# Altium schematic sheet FMC_Breakout.SchDoc
size A2
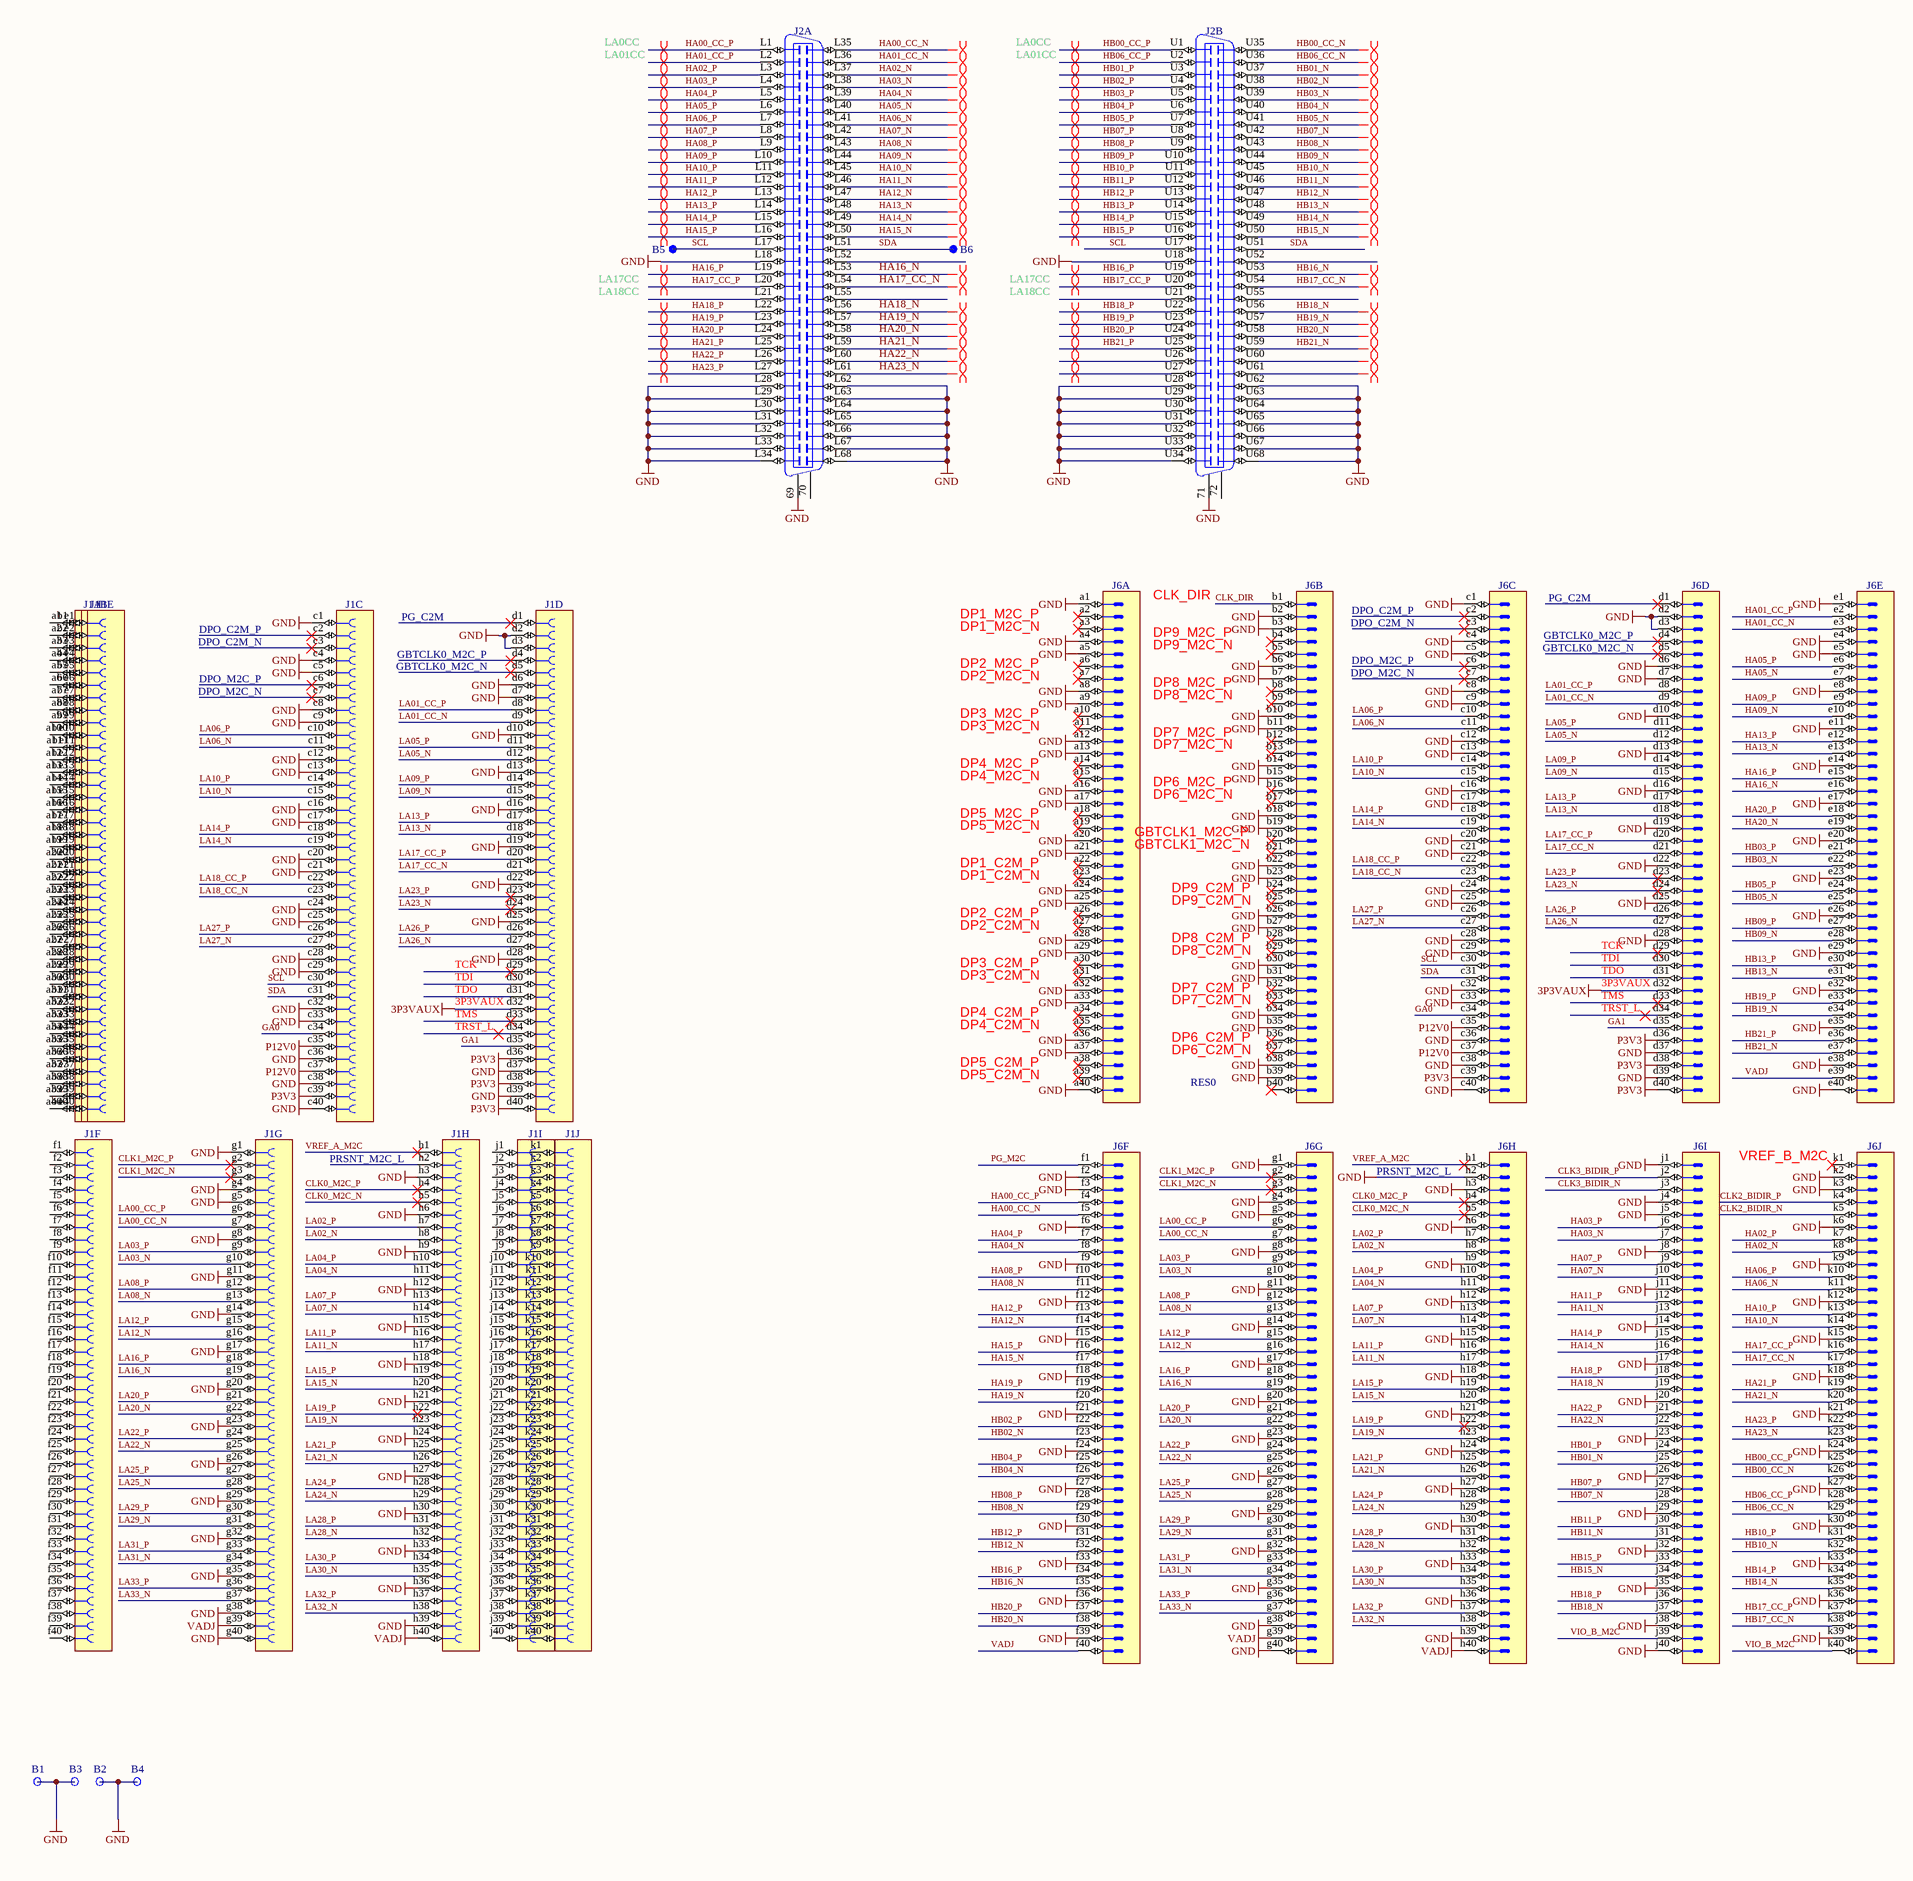
[diagram p0: FMC_Breakout.SchDoc]

## Parts
B1  Plated Hole  [MTG300_600]  (value not drawn)
B2  Plated Hole  [MTG300_600]  (value not drawn)
B3  Plated Hole  [MTG300_600]  (value not drawn)
B4  Plated Hole  [MTG300_600]  (value not drawn)
B5  SMD Pad  [C100]  (value not drawn)
B6  SMD Pad  [C100]  (value not drawn)
J1  VITA 57  [SAMTEC_ASP-134486-01]  (value not drawn)  (parts A,B,C,D,E,F,G,H,I,J of 10)
J2  VHDCI  [MOLEX_74337-0015]  (value not drawn)  (parts A,B of 2)
J6  VITA 57  [SAMTEC_ASP-134488-01]  (value not drawn)  (parts A,B,C,D,E,F,G,H,I,J of 10)

## Nets
3P3VAUX: J1.d32 J6.d32
GND: B1.1 B2.1 B3.1 B4.1 J1.c1 J1.c4 J1.c5 J1.c8 J1.c9 J1.c12 J1.c13 J1.c16 J1.c17 J1.c20 J1.c21 J1.c24 J1.c25 J1.c28 J1.c29 J1.c32 J1.c33 J1.c36 J1.c38 J1.c40 J1.d2 J1.d3 J1.d6 J1.d7 J1.d10 J1.d13 J1.d16 J1.d19 J1.d22 J1.d25 J1.d28 J1.d37 J1.d39 J1.g1 J1.g4 J1.g5 J1.g8 J1.g11 J1.g14 J1.g17 J1.g20 J1.g23 J1.g26 J1.g29 J1.g32 J1.g35 J1.g38 J1.g40 J1.h3 J1.h6 J1.h9 J1.h12 J1.h15 J1.h18 J1.h21 J1.h24 J1.h27 J1.h30 J1.h33 J1.h36 J1.h39 J2.69 J2.71 J2.L18 J2.L28 J2.L29 J2.L30 J2.L31 J2.L32 J2.L33 J2.L34 J2.L62 J2.L63 J2.L64 J2.L65 J2.L66 J2.L67 J2.L68 J2.U18 J2.U28 J2.U29 J2.U30 J2.U31 J2.U32 J2.U33 J2.U34 J2.U62 J2.U63 J2.U64 J2.U65 J2.U66 J2.U67 J2.U68 J6.a1 J6.a4 J6.a5 J6.a8 J6.a9 J6.a12 J6.a13 J6.a16 J6.a17 J6.a20 J6.a21 J6.a24 J6.a25 J6.a28 J6.a29 J6.a32 J6.a33 J6.a36 J6.a37 J6.a40 J6.b2 J6.b3 J6.b6 J6.b7 J6.b10 J6.b11 J6.b14 J6.b15 J6.b18 J6.b19 J6.b22 J6.b23 J6.b26 J6.b27 J6.b30 J6.b31 J6.b34 J6.b35 J6.b38 J6.b39 J6.c1 J6.c4 J6.c5 J6.c8 J6.c9 J6.c12 J6.c13 J6.c16 J6.c17 J6.c20 J6.c21 J6.c24 J6.c25 J6.c28 J6.c29 J6.c32 J6.c33 J6.c36 J6.c38 J6.c40 J6.d2 J6.d3 J6.d6 J6.d7 J6.d10 J6.d13 J6.d16 J6.d19 J6.d22 J6.d25 J6.d28 J6.d37 J6.d39 J6.e1 J6.e4 J6.e5 J6.e8 J6.e11 J6.e14 J6.e17 J6.e20 J6.e23 J6.e26 J6.e29 J6.e32 J6.e35 J6.e38 J6.e40 J6.f2 J6.f3 J6.f6 J6.f9 J6.f12 J6.f15 J6.f18 J6.f21 J6.f24 J6.f27 J6.f30 J6.f33 J6.f36 J6.f39 J6.g1 J6.g4 J6.g5 J6.g8 J6.g11 J6.g14 J6.g17 J6.g20 J6.g23 J6.g26 J6.g29 J6.g32 J6.g35 J6.g38 J6.g40 J6.h2 J6.h3 J6.h6 J6.h9 J6.h12 J6.h15 J6.h18 J6.h21 J6.h24 J6.h27 J6.h30 J6.h33 J6.h36 J6.h39 J6.j1 J6.j4 J6.j5 J6.j8 J6.j11 J6.j14 J6.j17 J6.j20 J6.j23 J6.j26 J6.j29 J6.j32 J6.j35 J6.j38 J6.j40 J6.k2 J6.k3 J6.k6 J6.k9 J6.k12 J6.k15 J6.k18 J6.k21 J6.k24 J6.k27 J6.k30 J6.k33 J6.k36 J6.k39
P3V3: J1.c39 J1.d36 J1.d38 J1.d40 J6.c39 J6.d36 J6.d38 J6.d40
P12V0: J1.c35 J1.c37 J6.c35 J6.c37
VADJ: J1.g39 J1.h40 J6.e39 J6.f40 J6.g39 J6.h40
CLK0_M2C_N: J1.h5 J6.h5
CLK0_M2C_P: J1.h4 J6.h4
CLK1_M2C_N: J1.g3 J6.g3
CLK1_M2C_P: J1.g2 J6.g2
CLK2_BIDIR_N: J6.k5
CLK2_BIDIR_P: J6.k4
CLK3_BIDIR_N: J6.j3
CLK3_BIDIR_P: J6.j2
CLK_DIR: J6.b1
GA0: J1.c34 J6.c34
GA1: J1.d35 J6.d35
HA00_CC_N: J2.L35 J6.f5
HA00_CC_P: J2.L1 J6.f4
HA01_CC_N: J2.L36 J6.e3
HA01_CC_P: J2.L2 J6.e2
HA02_N: J2.L37 J6.k8
HA02_P: J2.L3 J6.k7
HA03_N: J2.L38 J6.j7
HA03_P: J2.L4 J6.j6
HA04_N: J2.L39 J6.f8
HA04_P: J2.L5 J6.f7
HA05_N: J2.L40 J6.e7
HA05_P: J2.L6 J6.e6
HA06_N: J2.L41 J6.k11
HA06_P: J2.L7 J6.k10
HA07_N: J2.L42 J6.j10
HA07_P: J2.L8 J6.j9
HA08_N: J2.L43 J6.f11
HA08_P: J2.L9 J6.f10
HA09_N: J2.L44 J6.e10
HA09_P: J2.L10 J6.e9
HA10_N: J2.L45 J6.k14
HA10_P: J2.L11 J6.k13
HA11_N: J2.L46 J6.j13
HA11_P: J2.L12 J6.j12
HA12_N: J2.L47 J6.f14
HA12_P: J2.L13 J6.f13
HA13_N: J2.L48 J6.e13
HA13_P: J2.L14 J6.e12
HA14_N: J2.L49 J6.j16
HA14_P: J2.L15 J6.j15
HA15_N: J2.L50 J6.f17
HA15_P: J2.L16 J6.f16
HA16_N: J2.L53 J6.e16
HA16_P: J2.L19 J6.e15
HA17_CC_N: J2.L54 J6.k17
HA17_CC_P: J2.L20 J6.k16
HA18_N: J2.L56 J6.j19
HA18_P: J2.L22 J6.j18
HA19_N: J2.L57 J6.f20
HA19_P: J2.L23 J6.f19
HA20_N: J2.L58 J6.e19
HA20_P: J2.L24 J6.e18
HA21_N: J2.L59 J6.k20
HA21_P: J2.L25 J6.k19
HA22_N: J2.L60 J6.j22
HA22_P: J2.L26 J6.j21
HA23_N: J2.L61 J6.k23
HA23_P: J2.L27 J6.k22
HB00_CC_N: J2.U35 J6.k26
HB00_CC_P: J2.U1 J6.k25
HB01_N: J2.U37 J6.j25
HB01_P: J2.U3 J6.j24
HB02_N: J2.U38 J6.f23
HB02_P: J2.U4 J6.f22
HB03_N: J2.U39 J6.e22
HB03_P: J2.U5 J6.e21
HB04_N: J2.U40 J6.f26
HB04_P: J2.U6 J6.f25
HB05_N: J2.U41 J6.e25
HB05_P: J2.U7 J6.e24
HB06_CC_N: J2.U36 J6.k29
HB06_CC_P: J2.U2 J6.k28
HB07_N: J2.U42 J6.j28
HB07_P: J2.U8 J6.j27
HB08_N: J2.U43 J6.f29
HB08_P: J2.U9 J6.f28
HB09_N: J2.U44 J6.e28
HB09_P: J2.U10 J6.e27
HB10_N: J2.U45 J6.k32
HB10_P: J2.U11 J6.k31
HB11_N: J2.U46 J6.j31
HB11_P: J2.U12 J6.j30
HB12_N: J2.U47 J6.f32
HB12_P: J2.U13 J6.f31
HB13_N: J2.U48 J6.e31
HB13_P: J2.U14 J6.e30
HB14_N: J2.U49 J6.k35
HB14_P: J2.U15 J6.k34
HB15_N: J2.U50 J6.j34
HB15_P: J2.U16 J6.j33
HB16_N: J2.U53 J6.f35
HB16_P: J2.U19 J6.f34
HB17_CC_N: J2.U54 J6.k38
HB17_CC_P: J2.U20 J6.k37
HB18_N: J2.U56 J6.j37
HB18_P: J2.U22 J6.j36
HB19_N: J2.U57 J6.e34
HB19_P: J2.U23 J6.e33
HB20_N: J2.U58 J6.f38
HB20_P: J2.U24 J6.f37
HB21_N: J2.U59 J6.e37
HB21_P: J2.U25 J6.e36
LA00_CC_N: J1.g7 J6.g7
LA00_CC_P: J1.g6 J6.g6
LA01_CC_N: J1.d9 J6.d9
LA01_CC_P: J1.d8 J6.d8
LA02_N: J1.h8 J6.h8
LA02_P: J1.h7 J6.h7
LA03_N: J1.g10 J6.g10
LA03_P: J1.g9 J6.g9
LA04_N: J1.h11 J6.h11
LA04_P: J1.h10 J6.h10
LA05_N: J1.d12 J6.d12
LA05_P: J1.d11 J6.d11
LA06_N: J1.c11 J6.c11
LA06_P: J1.c10 J6.c10
LA07_N: J1.h14 J6.h14
LA07_P: J1.h13 J6.h13
LA08_N: J1.g13 J6.g13
LA08_P: J1.g12 J6.g12
LA09_N: J1.d15 J6.d15
LA09_P: J1.d14 J6.d14
LA10_N: J1.c15 J6.c15
LA10_P: J1.c14 J6.c14
LA11_N: J1.h17 J6.h17
LA11_P: J1.h16 J6.h16
LA12_N: J1.g16 J6.g16
LA12_P: J1.g15 J6.g15
LA13_N: J1.d18 J6.d18
LA13_P: J1.d17 J6.d17
LA14_N: J1.c19 J6.c19
LA14_P: J1.c18 J6.c18
LA15_N: J1.h20 J6.h20
LA15_P: J1.h19 J6.h19
LA16_N: J1.g19 J6.g19
LA16_P: J1.g18 J6.g18
LA17_CC_N: J1.d21 J6.d21
LA17_CC_P: J1.d20 J6.d20
LA18_CC_N: J1.c23 J6.c23
LA18_CC_P: J1.c22 J6.c22
LA19_N: J1.h23 J6.h23
LA19_P: J1.h22 J6.h22
LA20_N: J1.g22 J6.g22
LA20_P: J1.g21 J6.g21
LA21_N: J1.h26 J6.h26
LA21_P: J1.h25 J6.h25
LA22_N: J1.g25 J6.g25
LA22_P: J1.g24 J6.g24
LA23_N: J1.d24 J6.d24
LA23_P: J1.d23 J6.d23
LA24_N: J1.h29 J6.h29
LA24_P: J1.h28 J6.h28
LA25_N: J1.g28 J6.g28
LA25_P: J1.g27 J6.g27
LA26_N: J1.d27 J6.d27
LA26_P: J1.d26 J6.d26
LA27_N: J1.c27 J6.c27
LA27_P: J1.c26 J6.c26
LA28_N: J1.h32 J6.h32
LA28_P: J1.h31 J6.h31
LA29_N: J1.g31 J6.g31
LA29_P: J1.g30 J6.g30
LA30_N: J1.h35 J6.h35
LA30_P: J1.h34 J6.h34
LA31_N: J1.g34 J6.g34
LA31_P: J1.g33 J6.g33
LA32_N: J1.h38 J6.h38
LA32_P: J1.h37 J6.h37
LA33_N: J1.g37 J6.g37
LA33_P: J1.g36 J6.g36
PG_M2C: J6.f1
SCL: B5.1 J1.c30 J2.L17 J2.U17 J6.c30
SDA: B6.1 J1.c31 J2.L51 J2.U51 J6.c31
TCK: J1.d29 J6.d29
TDI: J1.d30 J6.d30
TDO: J1.d31 J6.d31
TMS: J1.d33 J6.d33
TRST_L: J1.d34 J6.d34
VIO_B_M2C: J6.j39 J6.k40
VREF_A_M2C: J1.h1 J6.h1

Not connected (* = marked no-connect by the designer): J1 a1 a2 a3 a4 a5 a6 a7 a8 a9 a10 a11 a12 a13 a14 a15 a16 a17 a18 a19 a20 a21 a22 a23 a24 a25 a26 a27 a28 a29 a30 a31 a32 a33 a34 a35 a36 a37 a38 a39 a40 b1 b2 b3 b4 b5 b6 b7 b8 b9 b10 b11 b12 b13 b14 b15 b16 b17 b18 b19 b20 b21 b22 b23 b24 b25 b26 b27 b28 b29 b30 b31 b32 b33 b34 b35 b36 b37 b38 b39 b40 c2* c3* c6* c7* d1* d4* d5* e1 e2 e3 e4 e5 e6 e7 e8 e9 e10 e11 e12 e13 e14 e15 e16 e17 e18 e19 e20 e21 e22 e23 e24 e25 e26 e27 e28 e29 e30 e31 e32 e33 e34 e35 e36 e37 e38 e39 e40 f1 f2 f3 f4 f5 f6 f7 f8 f9 f10 f11 f12 f13 f14 f15 f16 f17 f18 f19 f20 f21 f22 f23 f24 f25 f26 f27 f28 f29 f30 f31 f32 f33 f34 f35 f36 f37 f38 f39 f40 h2 j1 j2 j3 j4 j5 j6 j7 j8 j9 j10 j11 j12 j13 j14 j15 j16 j17 j18 j19 j20 j21 j22 j23 j24 j25 j26 j27 j28 j29 j30 j31 j32 j33 j34 j35 j36 j37 j38 j39 j40 k1 k2 k3 k4 k5 k6 k7 k8 k9 k10 k11 k12 k13 k14 k15 k16 k17 k18 k19 k20 k21 k22 k23 k24 k25 k26 k27 k28 k29 k30 k31 k32 k33 k34 k35 k36 k37 k38 k39 k40; J2 70 72 L21(21) L52(52) L55(55) U21(21) U26(26) U27(27) U52(52) U55(55) U60(60) U61(61); J6 a2* a3* a6* a7* a10* a11* a14* a15* a18* a19* a22* a23* a26* a27* a30* a31* a34* a35* a38* a39* b4* b5* b8* b9* b12* b13* b16* b17* b20* b21* b24* b25* b28* b29* b32* b33* b36* b37* b40* c2* c3* c6* c7* d1* d4* d5* k1*

## Layout directives
differential pair: HA00_CC_N, HA00_CC_P, HA01_CC_N, HA01_CC_P, HA02_N, HA02_P, HA03_N, HA03_P, HA04_N, HA04_P, HA05_N, HA05_P, HA06_N, HA06_P, HA07_N, HA07_P, HA08_N, HA08_P, HA09_N, HA09_P, HA10_N, HA10_P, HA11_N, HA11_P, HA12_N, HA12_P, HA13_N, HA13_P, HA14_N, HA14_P, HA15_N, HA15_P, HA16_N, HA16_P, HA17_CC_N, HA17_CC_P, HA18_N, HA18_P, HA19_N, HA19_P, HA20_N, HA20_P, HA21_N, HA21_P, HA22_N, HA22_P, HA23_N, HA23_P, HB00_CC_N, HB00_CC_P, HB01_N, HB01_P, HB02_N, HB02_P, HB03_N, HB03_P, HB04_N, HB04_P, HB05_N, HB05_P, HB06_CC_N, HB06_CC_P, HB07_N, HB07_P, HB08_N, HB08_P, HB09_N, HB09_P, HB10_N, HB10_P, HB11_N, HB11_P, HB12_N, HB12_P, HB13_N, HB13_P, HB14_N, HB14_P, HB15_N, HB15_P, HB16_N, HB16_P, HB17_CC_N, HB17_CC_P, HB18_N, HB18_P, HB19_N, HB19_P, HB20_N, HB20_P, HB21_N, HB21_P, NetJ2_U26, NetJ2_U27, NetJ2_U60, NetJ2_U61

## Notes on the sheet
- LA0CC
- LA01CC
- (near B5) LA17CC
- LA17CC
- LA18CC
- DPO_C2M_P
- DPO_C2M_N
- PG_C2M
- GBTCLK0_M2C_P
- DP1_M2C_P
- DP1_M2C_N
- CLK_DIR
- DP9_M2C_P
- DP9_M2C_N
- DPO_M2C_P
- GBTCLK0_M2C_N
- DPO_M2C_N
- DP2_M2C_P
- DP2_M2C_N
- DP8_M2C_P
- DP8_M2C_N
- DP3_M2C_P
- DP3_M2C_N
- DP4_M2C_P
- DP4_M2C_N
- DP7_M2C_P
- DP7_M2C_N
- DP5_M2C_P
- DP5_M2C_N
- (near J6) GBTCLK1_M2C_P
- DP6_M2C_P
- DP6_M2C_N
- DP1_C2M_P
- DP1_C2M_N
- (near J6) GBTCLK1_M2C_N
- DP9_C2M_P
- DP9_C2M_N
- DP2_C2M_P
- DP2_C2M_N
- DP8_C2M_P
- DP8_C2M_N
- DP3_C2M_P
- DP3_C2M_N
- DP4_C2M_P
- DP4_C2M_N
- DP7_C2M_P
- DP7_C2M_N
- DP5_C2M_P
- DP5_C2M_N
- DP6_C2M_P
- DP6_C2M_N
- RES0
- (near J1) PRSNT_M2C_L
- (near J6) PRSNT_M2C_L
- VREF_B_M2C

## Library data of the parts
B1-B4 = PLATED_HOLE3.0_PAD6.0: Single Terminal Socket; Part Description: Plated Through Hole: Hole Dia.=3.0mm Pad Dia.=6.0mm; Mounted: No; Table: Pads; Part Number: PLATED_HOLE3.0_PAD6.0; Component Kind: Standard (No BOM); Component Type: Standard (No BOM); Designator: Single Terminal Socket; Library Reference: Single Terminal Socket; Pin Count: 1; Family: Plated Hole; Socket: No; SMD: No; Status: None; ComponentHeight: 0mm; Author: CERN DEM JLC; CreateDate: 26.05.2008; LatestRevisionDate: 26.05.2008; PackageDescription: Plated Through Hole: Hole Dia.=3.0mm Pad Dia.=6.0mm
B5 B6 = SMD_PAD_D1MM: Through Hole Pad; Part Description: 1mm Diameter SMD Pad; Mounted: No; Part Number: SMD_PAD_D1MM; Component Kind: Standard (No BOM); Component Type: Standard (No BOM); Pin Count: 1; Family: SMD Pad; Socket: No; SMD: No; Sense: No; Status: None; ComponentHeight: 0mm; HelpURL: Undefined; Author: CERN DEM JLC; CreateDate: 10.10.2017; LatestRevisionDate: 10.10.2017; PackageDescription: 1mm Diameter SMD Pad
J1 = SAMTEC_ASP-134486-01: Connector VITA 57, 400 Female contacts in 10 row abcdefghj; Part Description: 400 contacts (10 rows abcdefghj) Surface Mount Female Connector, VITA 57 (CC-HPC-10); Manufacturer: SAMTEC; PressFit: No; Part Number: SAMTEC_ASP-134486-01; Component Kind: Standard; Component Type: Standard; Pin Count: 400; Family: VITA 57; Mounted: Yes; Socket: No; SMD: Yes; Status: None; Manufacturer Part Number: ASP-134486-01; ComponentHeight: 6.55mm; HelpURL: \\cern.ch\dfs\Applications\Altium\Datasheets\SAMTEC_ASP-134486-01.pdf; Author: CERN DEM JLC; CreateDate: 30.04.2009; LatestRevisionDate: 17.08.2009; Sense: No
J2 = MOLEX_74337-0015: Very High Density Cable Interconnect (VHDCI ) 2x68 Female; Part Number: Delivered by GK; Part Description: 2x68 Positions, Pitch 0.8mm, Very Hight Density Right Angle Dual Stacked VHDCI Receptacle; Manufacturer: MOLEX; PressFit: No; Component Kind: Standard; Component Type: Standard; Pin Count: 140; Family: VHDCI; Mounted: Yes; Socket: No; SMD: No; Sense: No; Status: None; Manufacturer Part Number: Delivered by GK; ComponentHeight: 10.78mm; HelpURL: \\cern.ch\dfs\Applications\Altium\Datasheets\MOLEX_74337-0015.pdf; Author: CERN DEM JLC; CreateDate: 30.04.2014; LatestRevisionDate: 30.04.2014
J6 = SAMTEC_ASP-134488-01: Connector VITA 57, 400 Male contacts in 10 row abcdefghj; Part Description: 400 contacts (10 rows abcdefghj) Surface Mount Male Connector, VITA 57 (MC-HPC-10); Manufacturer: SAMTEC; Part Number: SAMTEC_ASP-134488-01; Component Kind: Standard; Component Type: Standard; Pin Count: 400; Family: VITA 57; Mounted: Yes; Socket: No; SMD: Yes; Status: None; Manufacturer Part Number: ASP-134488-01; ComponentHeight: 6.1mm; HelpURL: \\cern.ch\dfs\Applications\Altium\Datasheets\SAMTEC_ASP-134488-01.pdf; Author: CERN DEM JLC; CreateDate: 30/04/2009; LatestRevisionDate: 17/08/2009; Table: SAMTEC